# EasyEDA Pro project wukong01-Y003-HTOL - 2.eprj, board PCB1 (continued)
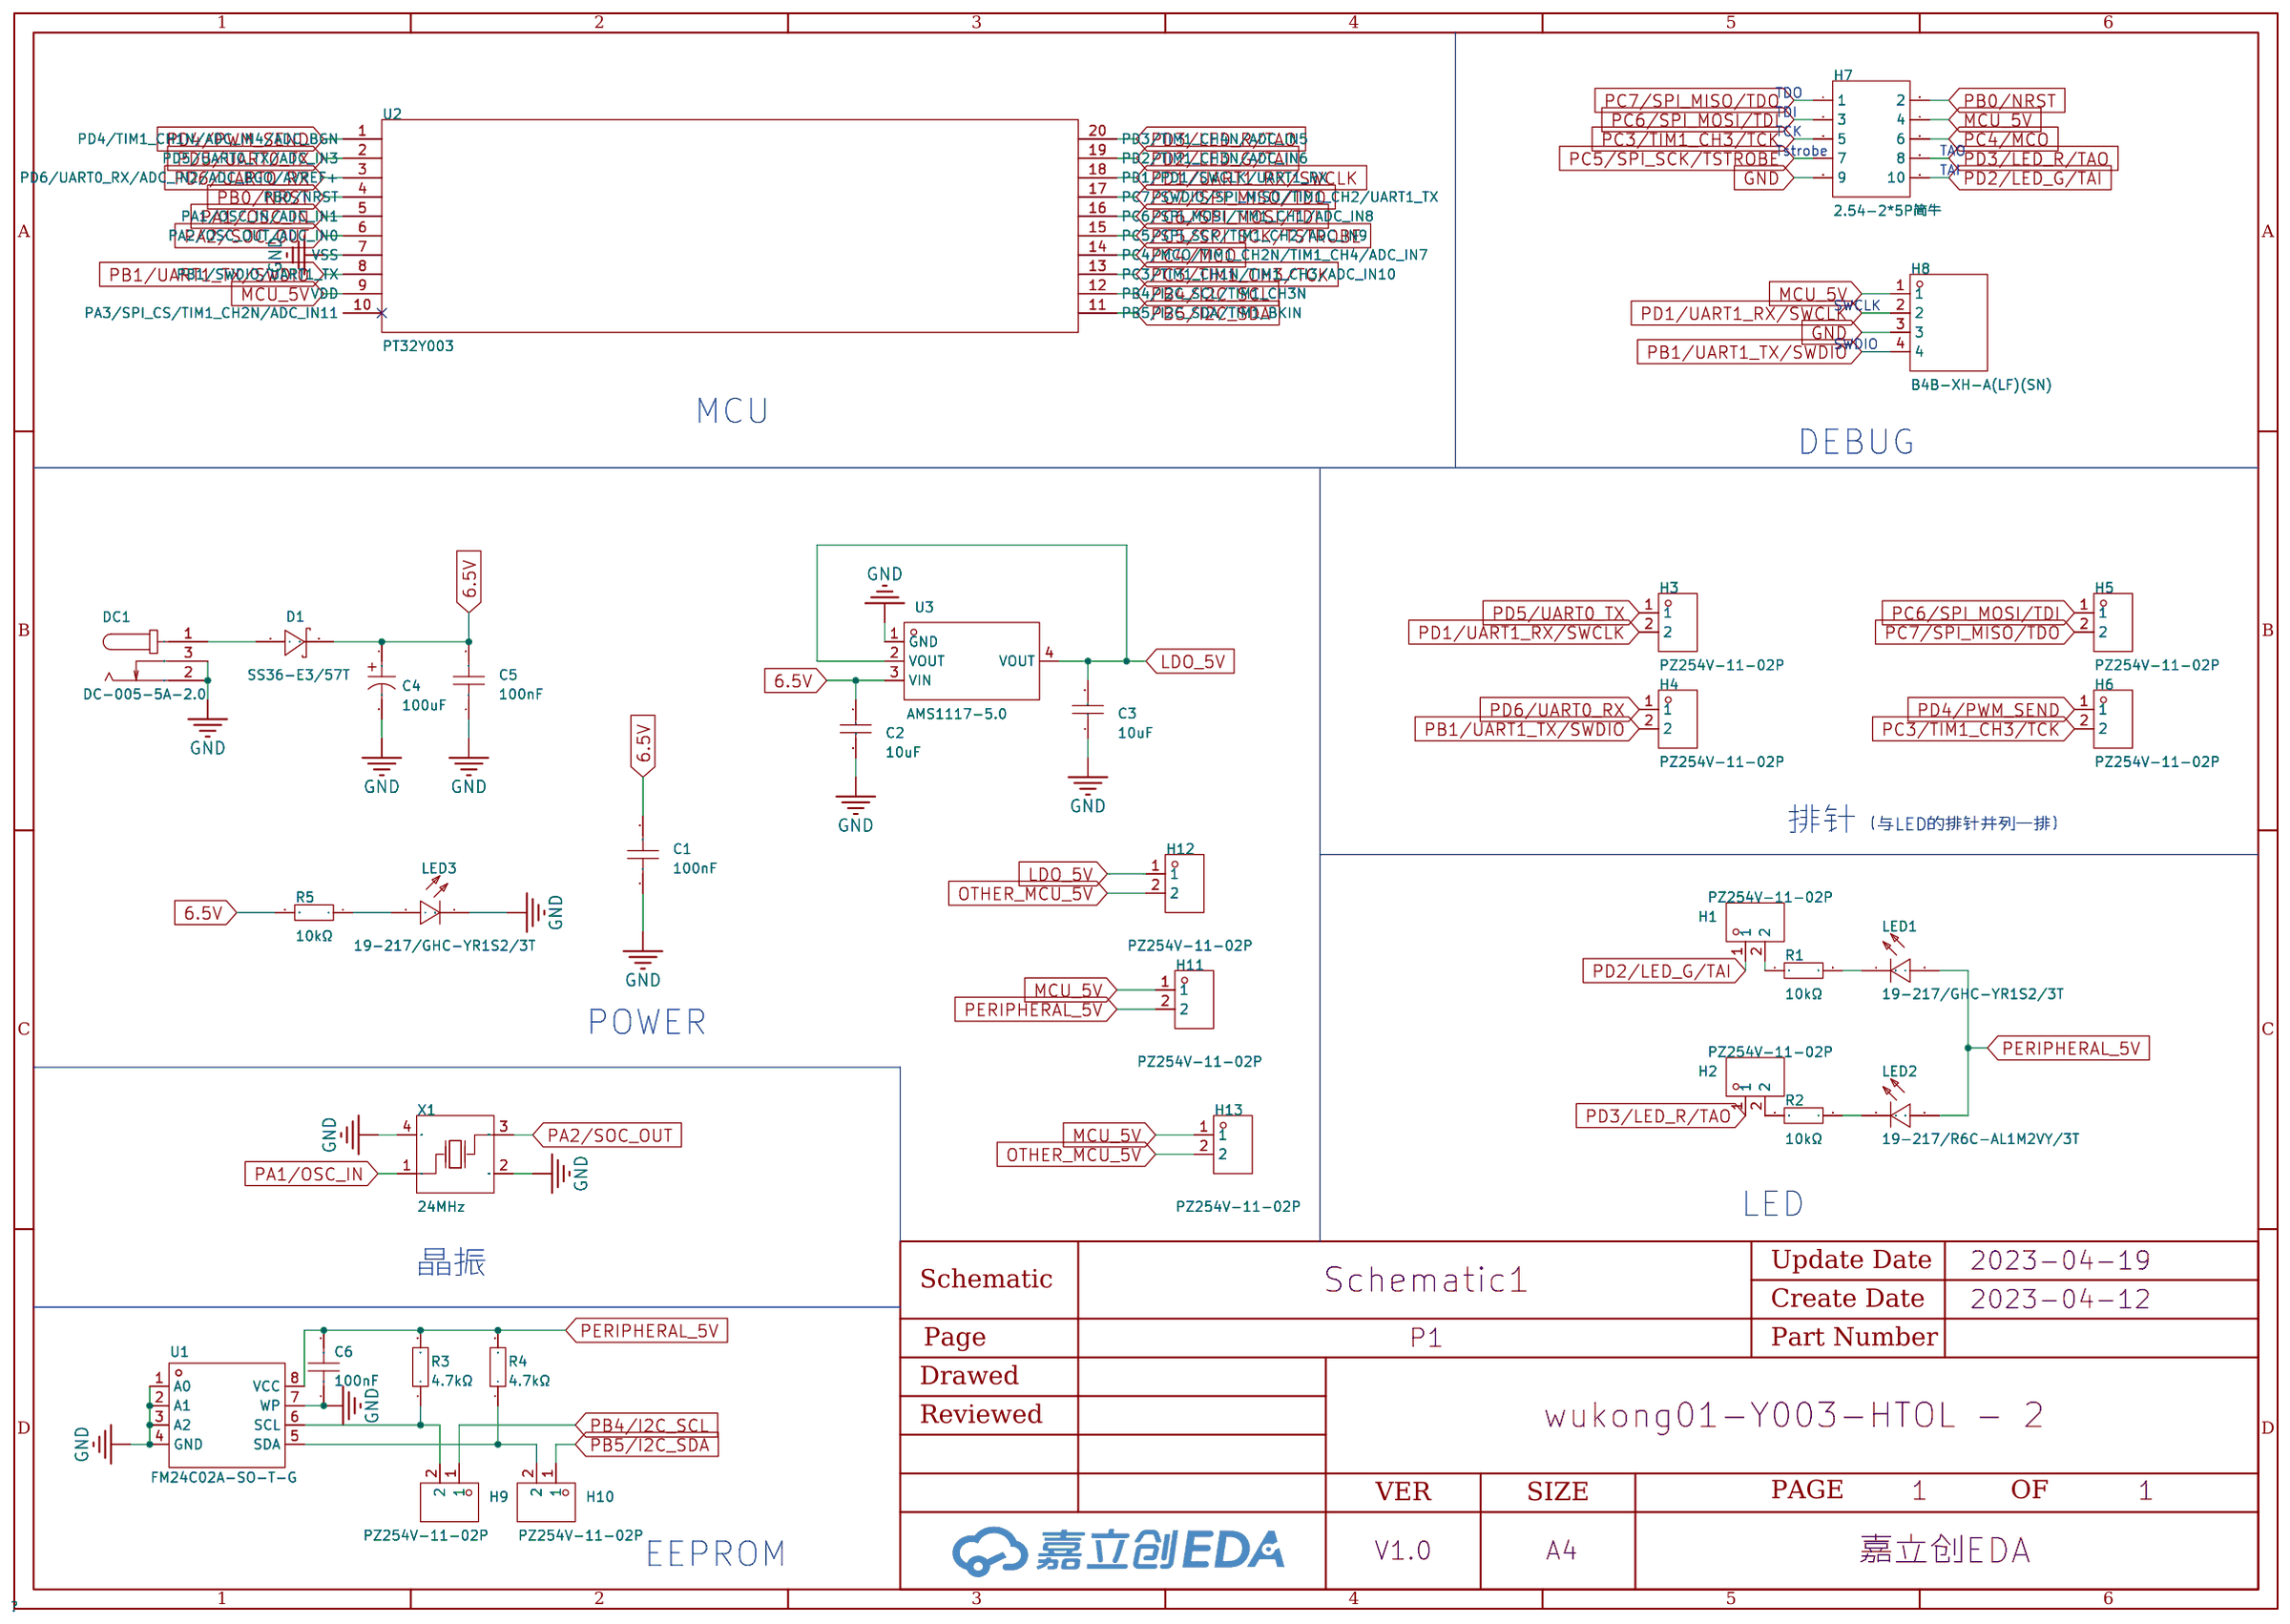
[diagram p0: schematic sheet]
## Routing (per net, layer and track width the routed paths; a pad name or vN(x,y) marks a point on that pad's centre or on a via; arc(x,y) is an arc through that point) (continued)
OTHER_MCU_5V: length 2260.2
  Top Layer w0.5: H12.2 v1(5.46,194.56) ; H13#10.2 v1(51.05,158.33) ; H13.2 v1(96.05,196.33) ; H13#15.2 v1(186.05,120.33) ; H13#32.2 v1(186.05,6.33) ; H13#17.2 v1(141.05,82.33) ; H13#27.2 v1(186.05,44.33) ; H13#8.2 v1(96.05,158.33) ; H13#24.2 v1(276.05,44.33) ; H13#31.2 v1(96.05,6.33) ; H13#30.2 v1(231.05,6.33) ; H12#2.2 v1(22.71,195.96) ; H13#29.2 v1(141.05,6.33) ; H13#25.2 v1(231.05,44.33) ; H13#26.2 v1(96.05,44.33) ; H13#18.2 v1(276.05,82.33) ; H13#16.2 v1(51.05,120.33) ; H13#6.2 v1(276.05,158.33) ; H13#23.2 v1(141.05,44.33) ; H13#21.2 v1(186.05,82.33) ; H13#14.2 v1(96.05,120.33) ; H13#28.2 v1(51.05,44.33) ; H13#20.2 v1(96.05,82.33) ; H13#11.2 v1(141.05,120.33) ; H13#13.2 v1(231.05,120.33) ; H13#5.2 v1(141.05,158.33) ; H13#22.2 v1(51.05,82.33) ; H13#3.2 v1(186.05,196.33) ; H13#9.2 v1(186.05,158.33) ; H13#4.2 v1(231.05,196.33) ; H12#3.2 v1(40.77,195.83) ; H13#12.2 v1(276.05,120.33) ; H13#7.2 v1(231.05,158.33) ; H13#2.2 v1(141.05,196.33) ; H13#19.2 v1(231.05,82.33)
  Bottom Layer w0.5: H12#4.2 57.15,196.34 58.55,194.94 282.32,194.94 284.73,192.53 284.73,161.04 280.67,156.97 141.66,156.97 141.05,157.58 v1(141.05,158.33) ; v1(141.05,196.33) 141.05,195.2 ; 141.05,81.2 186.05,81.2 ; 141.05,81.2 v1(141.05,82.33) ; 141.05,81.2 96.05,81.2 ; 186.05,81.2 v1(186.05,82.33) ; 186.05,81.2 231.05,81.2 ; 10.67,81.14 10.67,193.67 12.95,195.96 v1(22.71,195.96) ; 10.67,81.14 13.46,81.14 13.46,81.2 51.05,81.2 ; 10.67,81.14 10.67,45.72 13.46,42.93 95.4,42.93 96.05,43.58 v1(96.05,44.33) ; 51.05,81.2 v1(51.05,82.33) ; 51.05,81.2 96.05,81.2 ; v1(51.05,158.33) 51.05,157.23 ; 51.05,157.23 95.55,157.23 96.05,157.73 v1(96.05,158.33) ; 51.05,157.23 12.57,157.23 ; 51.05,157.23 51.05,157.2 ; v1(141.05,120.33) 141.05,119.2 ; v1(276.05,120.33) 276.05,119.2 275.85,119 16,119 12.57,122.43 12.57,157.23 ; 186.05,43.2 231.05,43.2 ; 186.05,43.2 141.48,43.2 141.05,43.62 v1(141.05,44.33) ; 186.05,43.2 v1(186.05,44.33) ; 231.05,43.2 276.05,43.2 ; 231.05,43.2 v1(231.05,44.33) ; 276.05,43.2 v1(276.05,44.33) ; 276.05,43.2 276.05,6.5 274.51,4.95 21.97,4.95 5.46,21.46 v1(5.46,194.56) ; v1(231.05,82.33) 231.05,81.2 ; 231.05,81.2 276.05,81.2 v1(276.05,82.33) ; v1(40.77,195.83) 40.77,194.82 15.24,194.82 12.57,192.15 12.57,157.23 ; v1(141.05,6.33) 141.05,5.2 ; v1(186.05,158.33) 186.05,157.2 ; v1(96.05,6.33) 96.05,5.2 ; v1(186.05,196.33) 186.05,195.2 ; v1(96.05,82.33) 96.05,81.2 ; v1(231.05,196.33) 231.05,195.2 ; v1(186.05,6.33) 186.05,5.2 ; v1(231.05,6.33) 231.05,5.2 ; v1(51.05,44.33) 51.05,43.2 ; v1(96.05,196.33) 96.05,195.2 ; v1(96.05,120.33) 96.05,119.2 ; v1(276.05,158.33) 276.05,157.2 ; v1(51.05,120.33) 51.05,119.2 ; v1(231.05,158.33) 231.05,157.2
PA1/OSC_IN: length 361.5
  Top Layer w0.254: U2#19.5 159.69,97.91 158.75,98.85 155.95,98.85 X1#20.1 ; X1#13.1 200.95,136.85 203.75,136.85 204.69,135.91 U2#14.5 ; U2#30.5 114.69,21.91 113.75,22.85 110.95,22.85 X1#29.1 ; X1#28.1 245.95,60.85 248.75,60.85 249.69,59.91 U2#27.5 ; U2#31.5 159.69,21.91 158.75,22.85 155.95,22.85 X1#31.1 ; U2#24.5 114.69,59.91 113.75,60.85 110.95,60.85 X1#23.1 ; U2#10.5 24.69,173.91 23.75,174.85 20.95,174.85 X1#6.1 ; X1#22.1 245.95,98.85 248.75,98.85 249.69,97.91 U2#21.5 ; U2#6.5 114.69,173.91 113.75,174.85 110.95,174.85 X1#5.1 ; U2#15.5 249.69,135.91 248.75,136.85 245.95,136.85 X1#16.1 ; X1#21.1 65.95,98.85 68.75,98.85 69.69,97.91 U2#17.5 ; X1#10.1 245.95,174.85 248.75,174.85 249.69,173.91 U2#9.5 ; U2#25.5 159.69,59.91 158.75,60.85 155.95,60.85 X1#26.1 ; X1#11.1 110.95,136.85 113.75,136.85 114.69,135.91 U2#12.5 ; U2#26.5 204.69,59.91 203.75,60.85 200.95,60.85 X1#25.1 ; X1#8.1 155.95,174.85 158.75,174.85 159.69,173.91 U2#7.5 ; U2#22.5 24.69,97.91 23.75,98.85 20.95,98.85 X1#18.1 ; U2#13.5 159.69,135.91 158.75,136.85 155.95,136.85 X1#14.1 ; U2#23.5 69.69,59.91 68.75,60.85 65.95,60.85 X1#27.1 ; U2#4.5 204.69,211.91 203.75,212.85 200.95,212.85 X1#4.1 ; X1#17.1 110.95,98.85 113.75,98.85 114.69,97.91 U2#18.5 ; X1#30.1 200.95,22.85 203.75,22.85 204.69,21.91 U2#32.5 ; X1#3.1 155.95,212.85 158.75,212.85 159.69,211.91 U2#3.5 ; X1#9.1 65.95,174.85 68.75,174.85 69.69,173.91 U2#5.5 ; U2#16.5 24.69,135.91 23.75,136.85 20.95,136.85 X1#12.1 ; X1#15.1 65.95,136.85 68.75,136.85 69.69,135.91 U2#11.5 ; U2#28.5 24.69,59.91 23.75,60.85 20.95,60.85 X1#24.1 ; X1#19.1 200.95,98.85 203.75,98.85 204.69,97.91 U2#20.5 ; U2#2.5 114.69,211.91 113.75,212.85 110.95,212.85 X1#2.1 ; U2.5 69.69,211.91 68.75,212.85 65.95,212.85 X1.1 ; U2#8.5 204.69,173.91 203.75,174.85 200.95,174.85 X1#7.1 ; X1#32.1 65.95,22.85 68.75,22.85 69.69,21.91 U2#29.5
PA2/SOC_OUT: length 452.1
  Top Layer w0.254: U2#21.6 250.46,97.26 249.13,95.93 244.89,95.93 X1#22.3 ; U2#28.6 25.46,59.26 24.13,57.93 19.89,57.93 X1#24.3 ; 108.71,211.11 109.89,209.93 114.13,209.93 115.46,211.26 U2#2.6 ; X1#18.3 19.89,95.93 24.13,95.93 25.46,97.26 U2#22.6 ; X1#20.3 154.89,95.93 159.13,95.93 160.46,97.26 U2#19.6 ; 63.71,97.11 64.89,95.93 69.13,95.93 70.46,97.26 U2#17.6 ; 108.71,97.11 109.89,95.93 114.13,95.93 115.46,97.26 U2#18.6 ; U2#12.6 115.46,135.26 114.13,133.93 109.89,133.93 108.71,135.11 ; U2#26.6 205.46,59.26 204.13,57.93 199.89,57.93 X1#25.3 ; 108.71,173.11 109.89,171.93 114.13,171.93 115.46,173.26 U2#6.6 ; U2#3.6 160.46,211.26 159.13,209.93 154.89,209.93 X1#3.3 ; X1#6.3 19.89,171.93 24.13,171.93 25.46,173.26 U2#10.6 ; X1#28.3 244.89,57.93 249.13,57.93 250.46,59.26 U2#27.6 ; X1#30.3 199.89,19.93 204.13,19.93 205.46,21.26 U2#32.6 ; 63.71,211.11 64.89,209.93 69.13,209.93 70.46,211.26 U2.6 ; U2#9.6 250.46,173.26 249.13,171.93 244.89,171.93 X1#10.3 ; U2#31.6 160.46,21.26 159.13,19.93 154.89,19.93 X1#31.3 ; 63.71,21.11 64.89,19.93 69.13,19.93 70.46,21.26 U2#29.6 ; 63.71,135.11 64.89,133.93 69.13,133.93 70.46,135.26 U2#11.6 ; 108.71,59.11 109.89,57.93 114.13,57.93 115.46,59.26 U2#24.6 ; U2#30.6 115.46,21.26 114.13,19.93 109.89,19.93 108.71,21.11 ; X1#14.3 154.89,133.93 159.13,133.93 160.46,135.26 U2#13.6 ; 63.71,173.11 64.89,171.93 69.13,171.93 70.46,173.26 U2#5.6 ; U2#15.6 250.46,135.26 249.13,133.93 244.89,133.93 X1#16.3 ; U2#14.6 205.46,135.26 204.13,133.93 199.89,133.93 X1#13.3 ; U2#7.6 160.46,173.26 159.13,171.93 154.89,171.93 X1#8.3 ; X1#4.3 199.89,209.93 204.13,209.93 205.46,211.26 U2#4.6 ; U2#20.6 205.46,97.26 204.13,95.93 199.89,95.93 X1#19.3 ; U2#23.6 70.46,59.26 69.13,57.93 64.89,57.93 63.71,59.11 ; U2#8.6 205.46,173.26 204.13,171.93 199.89,171.93 X1#7.3 ; X1#26.3 154.89,57.93 159.13,57.93 160.46,59.26 U2#25.6 ; U2#16.6 25.46,135.26 24.13,133.93 19.89,133.93 X1#12.3
PB0/NRST: length 736.6
  Top Layer w0.254: U2#13.4 164.25,136.56 163.57,137.23 163.57,140.53 164.08,141.04 v1(174.75,141.04) ; U2#15.4 254.25,136.56 253.57,137.23 253.57,140.53 254.08,141.04 v1(264.75,141.04) ; v1(264.75,142.44) H7#16.2 ; v1(219.75,141.04) 209.08,141.04 208.57,140.53 208.57,137.23 209.25,136.56 U2#14.4 ; v1(264.75,104.44) H7#22.2 ; U2#3.4 164.25,212.56 163.57,213.23 163.57,216.53 164.08,217.04 v1(174.75,217.04) ; v1(84.75,28.44) 84.75,31.87 ; v1(129.75,142.44) H7#12.2 ; U2#28.4 29.25,60.56 28.58,61.23 28.58,64.53 29.08,65.04 v1(39.75,65.04) ; v1(264.75,66.44) 264.75,69.87 ; v1(264.75,65.04) 254.08,65.04 253.57,64.53 253.57,61.23 254.25,60.56 U2#27.4 ; U2#8.4 209.25,174.56 208.57,175.23 208.57,178.53 209.08,179.04 v1(219.75,179.04) ; v1(84.75,142.44) H7#11.2 ; U2#18.4 119.25,98.56 118.58,99.23 118.58,102.53 119.08,103.04 v1(129.75,103.04) ; v1(219.75,27.04) 209.08,27.04 208.57,26.53 208.57,23.23 209.25,22.56 U2#32.4 ; v1(264.75,180.44) H7#10.2 ; U2#17.4 74.25,98.56 73.58,99.23 73.58,102.53 74.08,103.04 v1(84.75,103.04) ; U2#2.4 119.25,212.56 118.58,213.23 118.58,216.53 119.08,217.04 v1(129.75,217.04) ; v1(174.75,180.44) H7#7.2 ; U2#21.4 254.25,98.56 253.57,99.23 253.57,102.53 254.08,103.04 v1(264.75,103.04) ; v1(219.75,142.44) H7#14.2 ; v1(39.75,66.44) 39.75,69.87 ; v1(174.75,28.44) 174.75,31.87 ; v1(84.75,27.04) 74.08,27.04 73.58,26.53 73.58,23.23 74.25,22.56 U2#29.4 ; U2#31.4 164.25,22.56 163.57,23.23 163.57,26.53 164.08,27.04 v1(174.75,27.04) ; U2#5.4 74.25,174.56 73.58,175.23 73.58,178.53 74.08,179.04 v1(84.75,179.04) ; v1(39.75,180.44) H7#9.2 ; v1(84.75,218.44) 84.75,221.87 ; v1(129.75,65.04) 119.08,65.04 118.58,64.53 118.58,61.23 119.25,60.56 U2#24.4 ; v1(129.75,27.04) 119.08,27.04 118.58,26.53 118.58,23.23 119.25,22.56 U2#30.4 ; v1(129.75,104.44) H7#18.2 ; v1(219.75,104.44) H7#20.2 ; v1(39.75,141.04) 29.08,141.04 28.58,140.53 28.58,137.23 29.25,136.56 U2#16.4 ; v1(39.75,103.04) 29.08,103.04 28.58,102.53 28.58,99.23 29.25,98.56 U2#22.4 ; v1(84.75,65.04) 74.08,65.04 73.58,64.53 73.58,61.23 74.25,60.56 U2#23.4 ; v1(174.75,66.44) 174.75,69.87 ; U2#25.4 164.25,60.56 163.57,61.23 163.57,64.53 164.08,65.04 v1(174.75,65.04) ; U2#9.4 254.25,174.56 253.57,175.23 253.57,178.53 254.08,179.04 v1(264.75,179.04) ; v1(219.75,217.04) 209.08,217.04 208.57,216.53 208.57,213.23 209.25,212.56 U2#4.4 ; v1(174.75,103.04) 164.08,103.04 163.57,102.53 163.57,99.23 164.25,98.56 U2#19.4 ; v1(219.75,180.44) H7#8.2 ; v1(174.75,218.44) 174.75,221.87 ; U2#26.4 209.25,60.56 208.57,61.23 208.57,64.53 209.08,65.04 v1(219.75,65.04) ; v1(129.75,179.04) 119.08,179.04 118.58,178.53 118.58,175.23 119.25,174.56 U2#6.4 ; v1(219.75,103.04) 209.08,103.04 208.57,102.53 208.57,99.23 209.25,98.56 U2#20.4 ; v1(84.75,217.04) 74.08,217.04 73.58,216.53 73.58,213.23 74.25,212.56 U2.4 ; v1(129.75,141.04) 119.08,141.04 118.58,140.53 118.58,137.23 119.25,136.56 U2#12.4 ; v1(129.75,28.44) 129.75,31.87 ; U2#10.4 29.25,174.56 28.58,175.23 28.58,178.53 29.08,179.04 v1(39.75,179.04) ; v1(129.75,218.44) 129.75,221.87 ; v1(219.75,218.44) 219.75,221.87 ; v1(219.75,66.44) 219.75,69.87 ; v1(129.75,66.44) 129.75,69.87 ; v1(39.75,142.44) H7#15.2 ; v1(129.75,180.44) H7#6.2 ; v1(84.75,180.44) H7#5.2 ; U2#11.4 74.25,136.56 73.58,137.23 73.58,140.53 74.08,141.04 v1(84.75,141.04) ; v1(219.75,28.44) 219.75,31.87 ; v1(174.75,142.44) H7#13.2 ; v1(39.75,104.44) H7#21.2 ; v1(174.75,104.44) H7#19.2 ; v1(84.75,66.44) 84.75,69.87 ; v1(174.75,179.04) 164.08,179.04 163.57,178.53 163.57,175.23 164.25,174.56 U2#7.4 ; v1(84.75,104.44) H7#17.2
  Bottom Layer w0.254: v1(129.75,217.04) v1(129.75,218.44) ; v1(264.75,179.04) v1(264.75,180.44) ; v1(129.75,179.04) v1(129.75,180.44) ; v1(129.75,27.04) v1(129.75,28.44) ; v1(264.75,65.04) v1(264.75,66.44) ; v1(219.75,217.04) v1(219.75,218.44) ; v1(129.75,103.04) v1(129.75,104.44) ; v1(39.75,65.04) v1(39.75,66.44) ; v1(219.75,27.04) v1(219.75,28.44) ; v1(129.75,65.04) v1(129.75,66.44) ; v1(219.75,103.04) v1(219.75,104.44) ; v1(84.75,179.04) v1(84.75,180.44) ; v1(84.75,217.04) v1(84.75,218.44) ; v1(84.75,27.04) v1(84.75,28.44) ; v1(174.75,103.04) v1(174.75,104.44) ; v1(39.75,141.04) v1(39.75,142.44) ; v1(39.75,179.04) v1(39.75,180.44) ; v1(174.75,141.04) v1(174.75,142.44) ; v1(264.75,103.04) v1(264.75,104.44) ; v1(174.75,65.04) v1(174.75,66.44) ; v1(84.75,65.04) v1(84.75,66.44) ; v1(84.75,141.04) v1(84.75,142.44) ; v1(219.75,141.04) v1(219.75,142.44) ; v1(219.75,65.04) v1(219.75,66.44) ; v1(174.75,179.04) v1(174.75,180.44) ; v1(129.75,141.04) v1(129.75,142.44) ; v1(174.75,27.04) v1(174.75,28.44) ; v1(39.75,103.04) v1(39.75,104.44) ; v1(84.75,103.04) v1(84.75,104.44) ; v1(174.75,217.04) v1(174.75,218.44) ; v1(219.75,179.04) v1(219.75,180.44) ; v1(264.75,141.04) v1(264.75,142.44)
PB1/UART1_TX/SWDIO: length 2384.1
  Top Layer w0.254: H4#24.2 96.05,76.73 95.17,77.62 65.57,77.62 64.81,76.85 H8#23.4 61.64,74.06 60.37,72.79 60.37,58.69 61.76,57.3 69.38,57.3 70.05,57.96 U2#23.8 ; U2#10.8 25.04,171.96 24.38,171.3 16.76,171.3 15.37,172.69 15.37,186.79 16.64,188.06 H8#8.4 19.81,190.85 20.57,191.62 50.16,191.62 51.05,190.73 H4#8.2 ; H4#21.2 186.05,114.73 185.16,115.62 155.57,115.62 154.81,114.85 H8#21.4 151.64,112.06 150.37,110.79 150.37,96.69 151.76,95.3 159.38,95.3 160.04,95.96 U2#19.8 ; U2#17.8 70.05,95.96 69.38,95.3 61.76,95.3 60.37,96.69 60.37,110.79 61.64,112.06 H8#17.4 64.81,114.85 65.57,115.62 95.17,115.62 96.05,114.73 H4#18.2 ; H4#28.2 276.05,76.73 275.17,77.62 245.57,77.62 244.81,76.85 H8#28.4 241.64,74.06 240.37,72.79 240.37,58.69 241.76,57.3 249.38,57.3 250.04,57.96 U2#27.8 ; U2#22.8 25.04,95.96 24.38,95.3 16.76,95.3 15.37,96.69 15.37,110.79 16.64,112.06 H8#20.4 19.81,114.85 20.57,115.62 50.16,115.62 51.05,114.73 H4#20.2 ; U2#3.8 160.04,209.96 159.38,209.3 151.76,209.3 150.37,210.69 150.37,224.79 151.64,226.06 H8#3.4 154.81,228.85 155.57,229.62 185.16,229.62 186.05,228.73 H4#3.2 ; U2#24.8 115.05,57.96 114.38,57.3 106.76,57.3 105.37,58.69 105.37,72.79 106.64,74.06 H8#24.4 109.81,76.85 110.57,77.62 140.16,77.62 141.05,76.73 H4#25.2 ; U2#9.8 250.04,171.96 249.38,171.3 241.76,171.3 240.37,172.69 240.37,186.79 241.64,188.06 H8#10.4 244.81,190.85 245.57,191.62 275.17,191.62 276.05,190.73 H4#10.2 ; U2#25.8 160.04,57.96 159.38,57.3 151.76,57.3 150.37,58.69 150.37,72.79 151.64,74.06 H8#27.4 154.81,76.85 155.57,77.62 185.16,77.62 186.05,76.73 H4#27.2 ; U2.8 70.05,209.96 69.38,209.3 61.76,209.3 60.37,210.69 60.37,224.79 61.64,226.06 H8.4 64.81,228.85 65.57,229.62 95.17,229.62 96.05,228.73 H4.2 ; U2#30.8 115.05,19.96 114.38,19.3 106.76,19.3 105.37,20.69 105.37,34.79 106.64,36.06 H8#30.4 109.81,38.85 110.57,39.62 140.16,39.62 141.05,38.73 H4#31.2 ; H4#7.2 141.05,190.73 140.16,191.62 110.57,191.62 109.81,190.85 H8#6.4 106.64,188.06 105.37,186.79 105.37,172.69 106.76,171.3 114.38,171.3 115.05,171.96 U2#6.8 ; U2#2.8 115.05,209.96 114.38,209.3 106.76,209.3 105.37,210.69 105.37,224.79 106.64,226.06 H8#2.4 109.81,228.85 110.57,229.62 140.16,229.62 141.05,228.73 H4#2.2 ; U2#28.8 25.04,57.96 24.38,57.3 16.76,57.3 15.37,58.69 15.37,72.79 16.64,74.06 H8#26.4 19.81,76.85 20.57,77.62 50.16,77.62 51.05,76.73 H4#26.2 ; H4#16.2 276.05,152.73 275.17,153.62 245.57,153.62 244.81,152.85 H8#16.4 241.64,150.06 240.37,148.79 240.37,134.69 241.76,133.3 249.38,133.3 250.04,133.96 U2#15.8 ; U2#12.8 115.05,133.96 114.38,133.3 106.76,133.3 105.37,134.69 105.37,148.79 106.64,150.06 H8#12.4 109.81,152.85 110.57,153.62 140.16,153.62 141.05,152.73 H4#13.2 ; U2#14.8 205.04,133.96 204.38,133.3 196.76,133.3 195.37,134.69 195.37,148.79 196.64,150.06 H8#13.4 199.81,152.85 200.57,153.62 230.16,153.62 231.05,152.73 H4#11.2 ; H4#9.2 186.05,190.73 185.16,191.62 155.57,191.62 154.81,190.85 H8#9.4 151.64,188.06 150.37,186.79 150.37,172.69 151.76,171.3 159.38,171.3 160.04,171.96 U2#7.8 ; U2#31.8 160.04,19.96 159.38,19.3 151.76,19.3 150.37,20.69 150.37,34.79 151.64,36.06 H8#32.4 154.81,38.85 155.57,39.62 185.16,39.62 186.05,38.73 H4#32.2 ; U2#8.8 205.04,171.96 204.38,171.3 196.76,171.3 195.37,172.69 195.37,186.79 196.64,188.06 H8#7.4 199.81,190.85 200.57,191.62 230.16,191.62 231.05,190.73 H4#5.2 ; U2#5.8 70.05,171.96 69.38,171.3 61.76,171.3 60.37,172.69 60.37,186.79 61.64,188.06 H8#5.4 64.81,190.85 65.57,191.62 95.17,191.62 96.05,190.73 H4#6.2 ; U2#32.8 205.04,19.96 204.38,19.3 196.76,19.3 195.37,20.69 195.37,34.79 196.64,36.06 H8#31.4 199.81,38.85 200.57,39.62 230.16,39.62 231.05,38.73 H4#29.2 ; U2#26.8 205.04,57.96 204.38,57.3 196.76,57.3 195.37,58.69 195.37,72.79 196.64,74.06 H8#25.4 199.81,76.85 200.57,77.62 230.16,77.62 231.05,76.73 H4#23.2 ; H4#22.2 276.05,114.73 275.17,115.62 245.57,115.62 244.81,114.85 H8#22.4 241.64,112.06 240.37,110.79 240.37,96.69 241.76,95.3 249.38,95.3 250.04,95.96 U2#21.8 ; U2#20.8 205.04,95.96 204.38,95.3 196.76,95.3 195.37,96.69 195.37,110.79 196.64,112.06 H8#19.4 199.81,114.85 200.57,115.62 230.16,115.62 231.05,114.73 H4#17.2 ; H4#19.2 141.05,114.73 140.16,115.62 110.57,115.62 109.81,114.85 H8#18.4 106.64,112.06 105.37,110.79 105.37,96.69 106.76,95.3 114.38,95.3 115.05,95.96 U2#18.8 ; U2#29.8 70.05,19.96 69.38,19.3 61.76,19.3 60.37,20.69 60.37,34.79 61.64,36.06 H8#29.4 64.81,38.85 65.57,39.62 95.17,39.62 96.05,38.73 H4#30.2 ; U2#16.8 25.04,133.96 24.38,133.3 16.76,133.3 15.37,134.69 15.37,148.79 16.64,150.06 H8#14.4 19.81,152.85 20.57,153.62 50.16,153.62 51.05,152.73 H4#14.2 ; U2#11.8 70.05,133.96 69.38,133.3 61.76,133.3 60.37,134.69 60.37,148.79 61.64,150.06 H8#11.4 64.81,152.85 65.57,153.62 95.17,153.62 96.05,152.73 H4#12.2 ; H4#4.2 231.05,228.73 230.16,229.62 200.57,229.62 199.81,228.85 H8#4.4 196.64,226.06 195.37,224.79 195.37,210.69 196.76,209.3 204.38,209.3 205.04,209.96 U2#4.8 ; U2#13.8 160.04,133.96 159.38,133.3 151.76,133.3 150.37,134.69 150.37,148.79 151.64,150.06 H8#15.4 154.81,152.85 155.57,153.62 185.16,153.62 186.05,152.73 H4#15.2
PB4/I2C_SCL: length 361.3
  Top Layer w0.254: U2#14.12 217.55,133.3 227.24,133.3 228.01,134.06 H9#11.1 ; H9#2.1 138.01,210.06 137.24,209.3 127.55,209.3 U2#2.12 ; U2#16.12 37.55,133.3 47.24,133.3 48.01,134.06 H9#16.1 ; H9#10.1 48.01,172.06 47.24,171.3 37.55,171.3 U2#10.12 ; H9#20.1 183.01,96.06 182.24,95.3 172.55,95.3 U2#19.12 ; U2#7.12 172.55,171.3 182.24,171.3 183.01,172.06 H9#8.1 ; H9#18.1 93.01,96.06 92.24,95.3 82.55,95.3 U2#17.12 ; H9#31.1 138.01,20.06 137.24,19.3 127.55,19.3 U2#30.12 ; U2#31.12 172.55,19.3 182.24,19.3 183.01,20.06 H9#32.1 ; U2#28.12 37.55,57.3 47.24,57.3 48.01,58.06 H9#28.1 ; H9#7.1 138.01,172.06 137.24,171.3 127.55,171.3 U2#6.12 ; H9#26.1 183.01,58.06 182.24,57.3 172.55,57.3 U2#25.12 ; H9#19.1 138.01,96.06 137.24,95.3 127.55,95.3 U2#18.12 ; H9#5.1 228.01,172.06 227.24,171.3 217.55,171.3 U2#8.12 ; U2#12.12 127.55,133.3 137.24,133.3 138.01,134.06 H9#13.1 ; U2#4.12 217.55,209.3 227.24,209.3 228.01,210.06 H9#4.1 ; H9#9.1 273.01,172.06 272.24,171.3 262.55,171.3 U2#9.12 ; U2#20.12 217.55,95.3 227.24,95.3 228.01,96.06 H9#17.1 ; H9#21.1 273.01,96.06 272.24,95.3 262.55,95.3 U2#21.12 ; U2#26.12 217.55,57.3 227.24,57.3 228.01,58.06 H9#23.1 ; U2#5.12 82.55,171.3 92.24,171.3 93.01,172.06 H9#6.1 ; H9#24.1 93.01,58.06 92.24,57.3 82.55,57.3 U2#23.12 ; U2#3.12 172.55,209.3 182.24,209.3 183.01,210.06 H9#3.1 ; U2#15.12 262.55,133.3 272.24,133.3 273.01,134.06 H9#15.1 ; H9#30.1 93.01,20.06 92.24,19.3 82.55,19.3 U2#29.12 ; H9#22.1 48.01,96.06 47.24,95.3 37.55,95.3 U2#22.12 ; U2#11.12 82.55,133.3 92.24,133.3 93.01,134.06 H9#12.1 ; U2#27.12 262.55,57.3 272.24,57.3 273.01,58.06 H9#27.1 ; H9.1 93.01,210.06 92.24,209.3 82.55,209.3 U2.12 ; U2#13.12 172.55,133.3 182.24,133.3 183.01,134.06 H9#14.1 ; U2#24.12 127.55,57.3 137.24,57.3 138.01,58.06 H9#25.1 ; U2#32.12 217.55,19.3 227.24,19.3 228.01,20.06 H9#29.1
PB5/I2C_SDA: length 366.2
  Top Layer w0.254: U2#4.11 227.38,208.66 H10#4.1 ; U2#8.11 227.38,170.66 H10#5.1 ; H10#16.1 47.38,132.66 U2#16.11 ; H10.1 92.38,208.66 U2.11 ; U2#32.11 227.38,18.66 H10#29.1 ; H10#20.1 182.38,94.66 U2#19.11 ; U2#14.11 227.38,132.66 H10#11.1 ; H10#26.1 182.38,56.66 U2#25.11 ; U2#28.11 47.38,56.66 H10#28.1 ; H10#12.1 92.38,132.66 U2#11.11 ; H10#3.1 182.38,208.66 U2#3.11 ; H10#9.1 272.38,170.66 U2#9.11 ; U2#15.11 272.38,132.66 H10#15.1 ; U2#30.11 137.38,18.66 H10#31.1 ; H10#13.1 137.38,132.66 U2#12.11 ; U2#10.11 47.38,170.66 H10#10.1 ; U2#22.11 47.38,94.66 H10#22.1 ; U2#31.11 182.38,18.66 H10#32.1 ; H10#25.1 137.38,56.66 U2#24.11 ; U2#18.11 137.38,94.66 H10#19.1 ; H10#27.1 272.38,56.66 U2#27.11 ; U2#13.11 182.38,132.66 H10#14.1 ; U2#29.11 92.38,18.66 H10#30.1 ; U2#5.11 92.38,170.66 H10#6.1 ; H10#7.1 137.38,170.66 U2#6.11 ; H10#24.1 92.38,56.66 U2#23.11 ; H10#23.1 227.38,56.66 U2#26.11 ; U2#2.11 137.38,208.66 H10#2.1 ; H10#17.1 227.38,94.66 U2#20.11 ; U2#17.11 92.38,94.66 H10#18.1 ; H10#8.1 182.38,170.66 U2#7.11 ; U2#21.11 272.38,94.66 H10#21.1
PC3/TIM1_CH3/TCK: length 1942
  Top Layer w0.254: v1(180.08,37.08) v1(180.08,38.85) 169.67,38.85 H7#31.5 ; v1(135.08,37.08) v1(135.08,38.85) 124.67,38.85 H7#30.5 ; U2#7.13 179.93,171.96 v1(179.96,171.93) ; v1(225.08,37.08) v1(225.08,38.85) 214.67,38.85 H7#32.5 ; U2#2.13 134.93,209.96 v1(134.96,209.93) ; v1(90.09,75.08) v1(90.09,76.85) 79.67,76.85 H7#23.5 ; H7#12.5 124.67,152.85 v1(135.08,152.85) v1(135.08,151.08) ; v1(225.08,189.08) v1(225.08,190.85) 214.67,190.85 H7#8.5 ; v1(89.96,95.93) 89.93,95.96 U2#17.13 ; v1(224.96,95.93) 224.93,95.96 U2#20.13 ; v1(90.09,189.08) v1(90.09,190.85) 79.67,190.85 H7#5.5 ; U2#9.13 269.93,171.96 v1(269.96,171.93) ; H7#29.5 79.67,38.85 v1(90.09,38.85) v1(90.09,37.08) ; H7#16.5 259.67,152.85 v1(270.08,152.85) v1(270.08,151.08) ; U2#27.13 269.93,57.96 v1(269.96,57.93) ; H7#24.5 124.67,76.85 v1(135.08,76.85) v1(135.08,75.08) ; v1(270.08,75.08) v1(270.08,76.85) 259.67,76.85 H7#28.5 ; v1(179.96,133.93) 179.93,133.96 U2#13.13 ; U2#21.13 269.93,95.96 v1(269.96,95.93) ; U2#6.13 134.93,171.96 v1(134.96,171.93) ; v1(44.96,57.93) 44.93,57.96 U2#28.13 ; v1(44.96,171.93) 44.93,171.96 U2#10.13 ; U2#29.13 89.93,19.96 v1(89.96,19.93) ; v1(89.96,209.93) 89.93,209.96 U2.13 ; v1(135.08,189.08) v1(135.08,190.85) 124.67,190.85 H7#6.5 ; v1(179.96,209.93) 179.93,209.96 U2#3.13 ; H7#3.5 169.67,228.85 v1(180.08,228.85) v1(180.08,227.08) ; H7#27.5 34.67,76.85 v1(45.09,76.85) v1(45.09,75.08) ; H7.5 79.67,228.85 v1(90.09,228.85) v1(90.09,227.08) ; H7#25.5 169.67,76.85 v1(180.08,76.85) v1(180.08,75.08) ; H7#19.5 169.67,114.85 v1(180.08,114.85) v1(180.08,113.08) ; v1(180.08,189.08) v1(180.08,190.85) 169.67,190.85 H7#7.5 ; U2#14.13 224.93,133.96 v1(224.96,133.93) ; U2#16.13 44.93,133.96 v1(44.96,133.93) ; U2#5.13 89.93,171.96 v1(89.96,171.93) ; U2#11.13 89.93,133.96 v1(89.96,133.93) ; U2#19.13 179.93,95.96 v1(179.96,95.93) ; U2#22.13 44.93,95.96 v1(44.96,95.93) ; v1(225.08,151.08) v1(225.08,152.85) 214.67,152.85 H7#14.5 ; U2#32.13 224.93,19.96 v1(224.96,19.93) ; v1(135.08,227.08) v1(135.08,228.85) 124.67,228.85 H7#2.5 ; v1(179.96,57.93) 179.93,57.96 U2#25.13 ; U2#8.13 224.93,171.96 v1(224.96,171.93) ; U2#4.13 224.93,209.96 v1(224.96,209.93) ; U2#18.13 134.93,95.96 v1(134.96,95.93) ; H7#21.5 34.67,114.85 v1(45.09,114.85) v1(45.09,113.08) ; H7#15.5 34.67,152.85 v1(45.09,152.85) v1(45.09,151.08) ; v1(270.08,189.08) v1(270.08,190.85) 259.67,190.85 H7#10.5 ; v1(134.96,133.93) 134.93,133.96 U2#12.13 ; v1(135.08,113.08) v1(135.08,114.85) 124.67,114.85 H7#18.5 ; v1(90.09,113.08) v1(90.09,114.85) 79.67,114.85 H7#17.5 ; v1(225.08,75.08) v1(225.08,76.85) 214.67,76.85 H7#26.5 ; v1(180.08,151.08) v1(180.08,152.85) 169.67,152.85 H7#13.5 ; H7#4.5 214.67,228.85 v1(225.08,228.85) v1(225.08,227.08) ; v1(224.96,57.93) 224.93,57.96 U2#26.13 ; U2#23.13 89.93,57.96 v1(89.96,57.93) ; U2#31.13 179.93,19.96 v1(179.96,19.93) ; v1(134.96,19.93) 134.93,19.96 U2#30.13 ; H7#20.5 214.67,114.85 v1(225.08,114.85) v1(225.08,113.08) ; v1(134.96,57.93) 134.93,57.96 U2#24.13 ; U2#15.13 269.93,133.96 v1(269.96,133.93) ; v1(90.09,151.08) v1(90.09,152.85) 79.67,152.85 H7#11.5 ; H7#9.5 34.67,190.85 v1(45.09,190.85) v1(45.09,189.08) ; v1(270.08,113.08) v1(270.08,114.85) 259.67,114.85 H7#22.5
  Bottom Layer w0.254: v1(180.08,227.08) 180.08,210.06 v1(179.96,209.93) ; H6#15.2 277.83,144.22 278.85,145.23 278.85,152.35 278.34,152.85 v1(270.08,152.85) 269.96,152.85 ; v1(90.09,37.08) 90.09,20.06 v1(89.96,19.93) ; v1(45.09,113.08) 45.09,96.06 v1(44.96,95.93) ; H6#30.2 232.83,30.22 233.85,31.23 233.85,38.35 233.34,38.85 v1(225.08,38.85) 224.96,38.85 ; H6#24.2 232.83,68.22 233.85,69.23 233.85,76.35 233.34,76.85 v1(225.08,76.85) 224.96,76.85 ; H6#9.2 277.83,182.22 278.85,183.23 278.85,190.35 278.34,190.85 v1(270.08,190.85) 269.96,190.85 ; v1(135.08,75.08) 135.08,58.06 v1(134.96,57.93) ; 134.96,228.85 v1(135.08,228.85) 143.34,228.85 143.85,228.35 143.85,221.23 142.83,220.22 H6#2.2 ; H6#25.2 142.83,68.22 143.85,69.23 143.85,76.35 143.34,76.85 v1(135.08,76.85) 134.96,76.85 ; v1(90.09,151.08) 90.09,134.06 v1(89.96,133.93) ; v1(224.96,133.93) 225.08,134.06 v1(225.08,151.08) ; v1(269.96,171.93) 270.08,172.06 v1(270.08,189.08) ; v1(134.96,171.93) 135.08,172.06 v1(135.08,189.08) ; v1(270.08,75.08) 270.08,58.06 v1(269.96,57.93) ; v1(179.96,57.93) 180.08,58.06 v1(180.08,75.08) ; 179.96,76.85 v1(180.08,76.85) 188.34,76.85 188.85,76.35 188.85,69.23 187.83,68.22 H6#26.2 ; H6#27.2 277.83,68.22 278.85,69.23 278.85,76.35 278.34,76.85 v1(270.08,76.85) 269.96,76.85 ; H6#13.2 142.83,144.22 143.85,145.23 143.85,152.35 143.34,152.85 v1(135.08,152.85) 134.96,152.85 ; v1(90.09,113.08) 90.09,96.06 v1(89.96,95.93) ; 179.96,114.85 v1(180.08,114.85) 188.34,114.85 188.85,114.35 188.85,107.23 187.83,106.22 H6#20.2 ; v1(179.96,171.93) 180.08,172.06 v1(180.08,189.08) ; H6#32.2 187.83,30.22 188.85,31.23 188.85,38.35 188.34,38.85 v1(180.08,38.85) 179.96,38.85 ; 224.96,152.85 v1(225.08,152.85) 233.34,152.85 233.85,152.35 233.85,145.23 232.83,144.22 H6#12.2 ; v1(45.09,151.08) 45.09,134.06 v1(44.96,133.93) ; H6#6.2 232.83,182.22 233.85,183.23 233.85,190.35 233.34,190.85 v1(225.08,190.85) 224.96,190.85 ; v1(270.08,151.08) 270.08,134.06 v1(269.96,133.93) ; v1(135.08,37.08) 135.08,20.06 v1(134.96,19.93) ; H6#11.2 97.83,144.22 98.85,145.23 98.85,152.35 98.34,152.85 v1(90.09,152.85) 89.96,152.85 ; H6#31.2 142.83,30.22 143.85,31.23 143.85,38.35 143.34,38.85 v1(135.08,38.85) 134.96,38.85 ; v1(135.08,151.08) 135.08,134.06 v1(134.96,133.93) ; v1(224.96,209.93) 225.08,210.06 v1(225.08,227.08) ; 269.96,114.85 v1(270.08,114.85) 278.34,114.85 278.85,114.35 278.85,107.23 277.83,106.22 H6#21.2 ; 224.96,114.85 v1(225.08,114.85) 233.34,114.85 233.85,114.35 233.85,107.23 232.83,106.22 H6#18.2 ; H6#3.2 187.83,220.22 188.85,221.23 188.85,228.35 188.34,228.85 v1(180.08,228.85) 179.96,228.85 ; 179.96,152.85 v1(180.08,152.85) 188.34,152.85 188.85,152.35 188.85,145.23 187.83,144.22 H6#14.2 ; v1(224.96,171.93) 225.08,172.06 v1(225.08,189.08) ; 89.96,114.85 v1(90.09,114.85) 98.34,114.85 98.85,114.35 98.85,107.23 97.83,106.22 H6#17.2 ; H6#10.2 52.83,182.22 53.85,183.23 53.85,190.35 53.34,190.85 v1(45.09,190.85) 44.96,190.85 ; v1(134.96,95.93) 135.08,96.06 v1(135.08,113.08) ; H6#22.2 52.83,106.22 53.85,107.23 53.85,114.35 53.34,114.85 v1(45.09,114.85) 44.96,114.85 ; v1(179.96,19.93) 180.08,20.06 v1(180.08,37.08) ; H6.2 97.83,220.22 98.85,221.23 98.85,228.35 98.34,228.85 v1(90.09,228.85) 89.96,228.85 ; v1(225.08,37.08) 225.08,20.06 v1(224.96,19.93) ; H6#4.2 232.83,220.22 233.85,221.23 233.85,228.35 233.34,228.85 v1(225.08,228.85) 224.96,228.85 ; v1(135.08,227.08) 135.08,210.06 v1(134.96,209.93) ; v1(44.96,57.93) 45.09,58.06 v1(45.09,75.08) ; v1(224.96,95.93) 225.08,96.06 v1(225.08,113.08) ; H6#8.2 187.83,182.22 188.85,183.23 188.85,190.35 188.34,190.85 v1(180.08,190.85) 179.96,190.85 ; v1(90.09,227.08) 90.09,210.06 v1(89.96,209.93) ; 44.96,152.85 v1(45.09,152.85) 53.34,152.85 53.85,152.35 53.85,145.23 52.83,144.22 H6#16.2 ; v1(45.09,189.08) 45.09,172.06 v1(44.96,171.93) ; v1(179.96,133.93) 180.08,134.06 v1(180.08,151.08) ; H6#28.2 52.83,68.22 53.85,69.23 53.85,76.35 53.34,76.85 v1(45.09,76.85) 44.96,76.85 ; v1(89.96,171.93) 90.09,172.06 v1(90.09,189.08) ; H6#5.2 97.83,182.22 98.85,183.23 98.85,190.35 98.34,190.85 v1(90.09,190.85) 89.96,190.85 ; H6#23.2 97.83,68.22 98.85,69.23 98.85,76.35 98.34,76.85 v1(90.09,76.85) 89.96,76.85 ; v1(225.08,75.08) 225.08,58.06 v1(224.96,57.93) ; 134.96,114.85 v1(135.08,114.85) 143.34,114.85 143.85,114.35 143.85,107.23 142.83,106.22 H6#19.2 ; v1(270.08,113.08) 270.08,96.06 v1(269.96,95.93) ; v1(89.96,57.93) 90.09,58.06 v1(90.09,75.08) ; H6#7.2 142.83,182.22 143.85,183.23 143.85,190.35 143.34,190.85 v1(135.08,190.85) 134.96,190.85 ; H6#29.2 97.83,30.22 98.85,31.23 98.85,38.35 98.34,38.85 v1(90.09,38.85) 89.96,38.85 ; v1(179.96,95.93) 180.08,96.06 v1(180.08,113.08)
PC4/MCO: length 888.1